# EasyEDA Pro project 成图大赛比赛样题参考.eprj (continued)
## Sheets (continued)
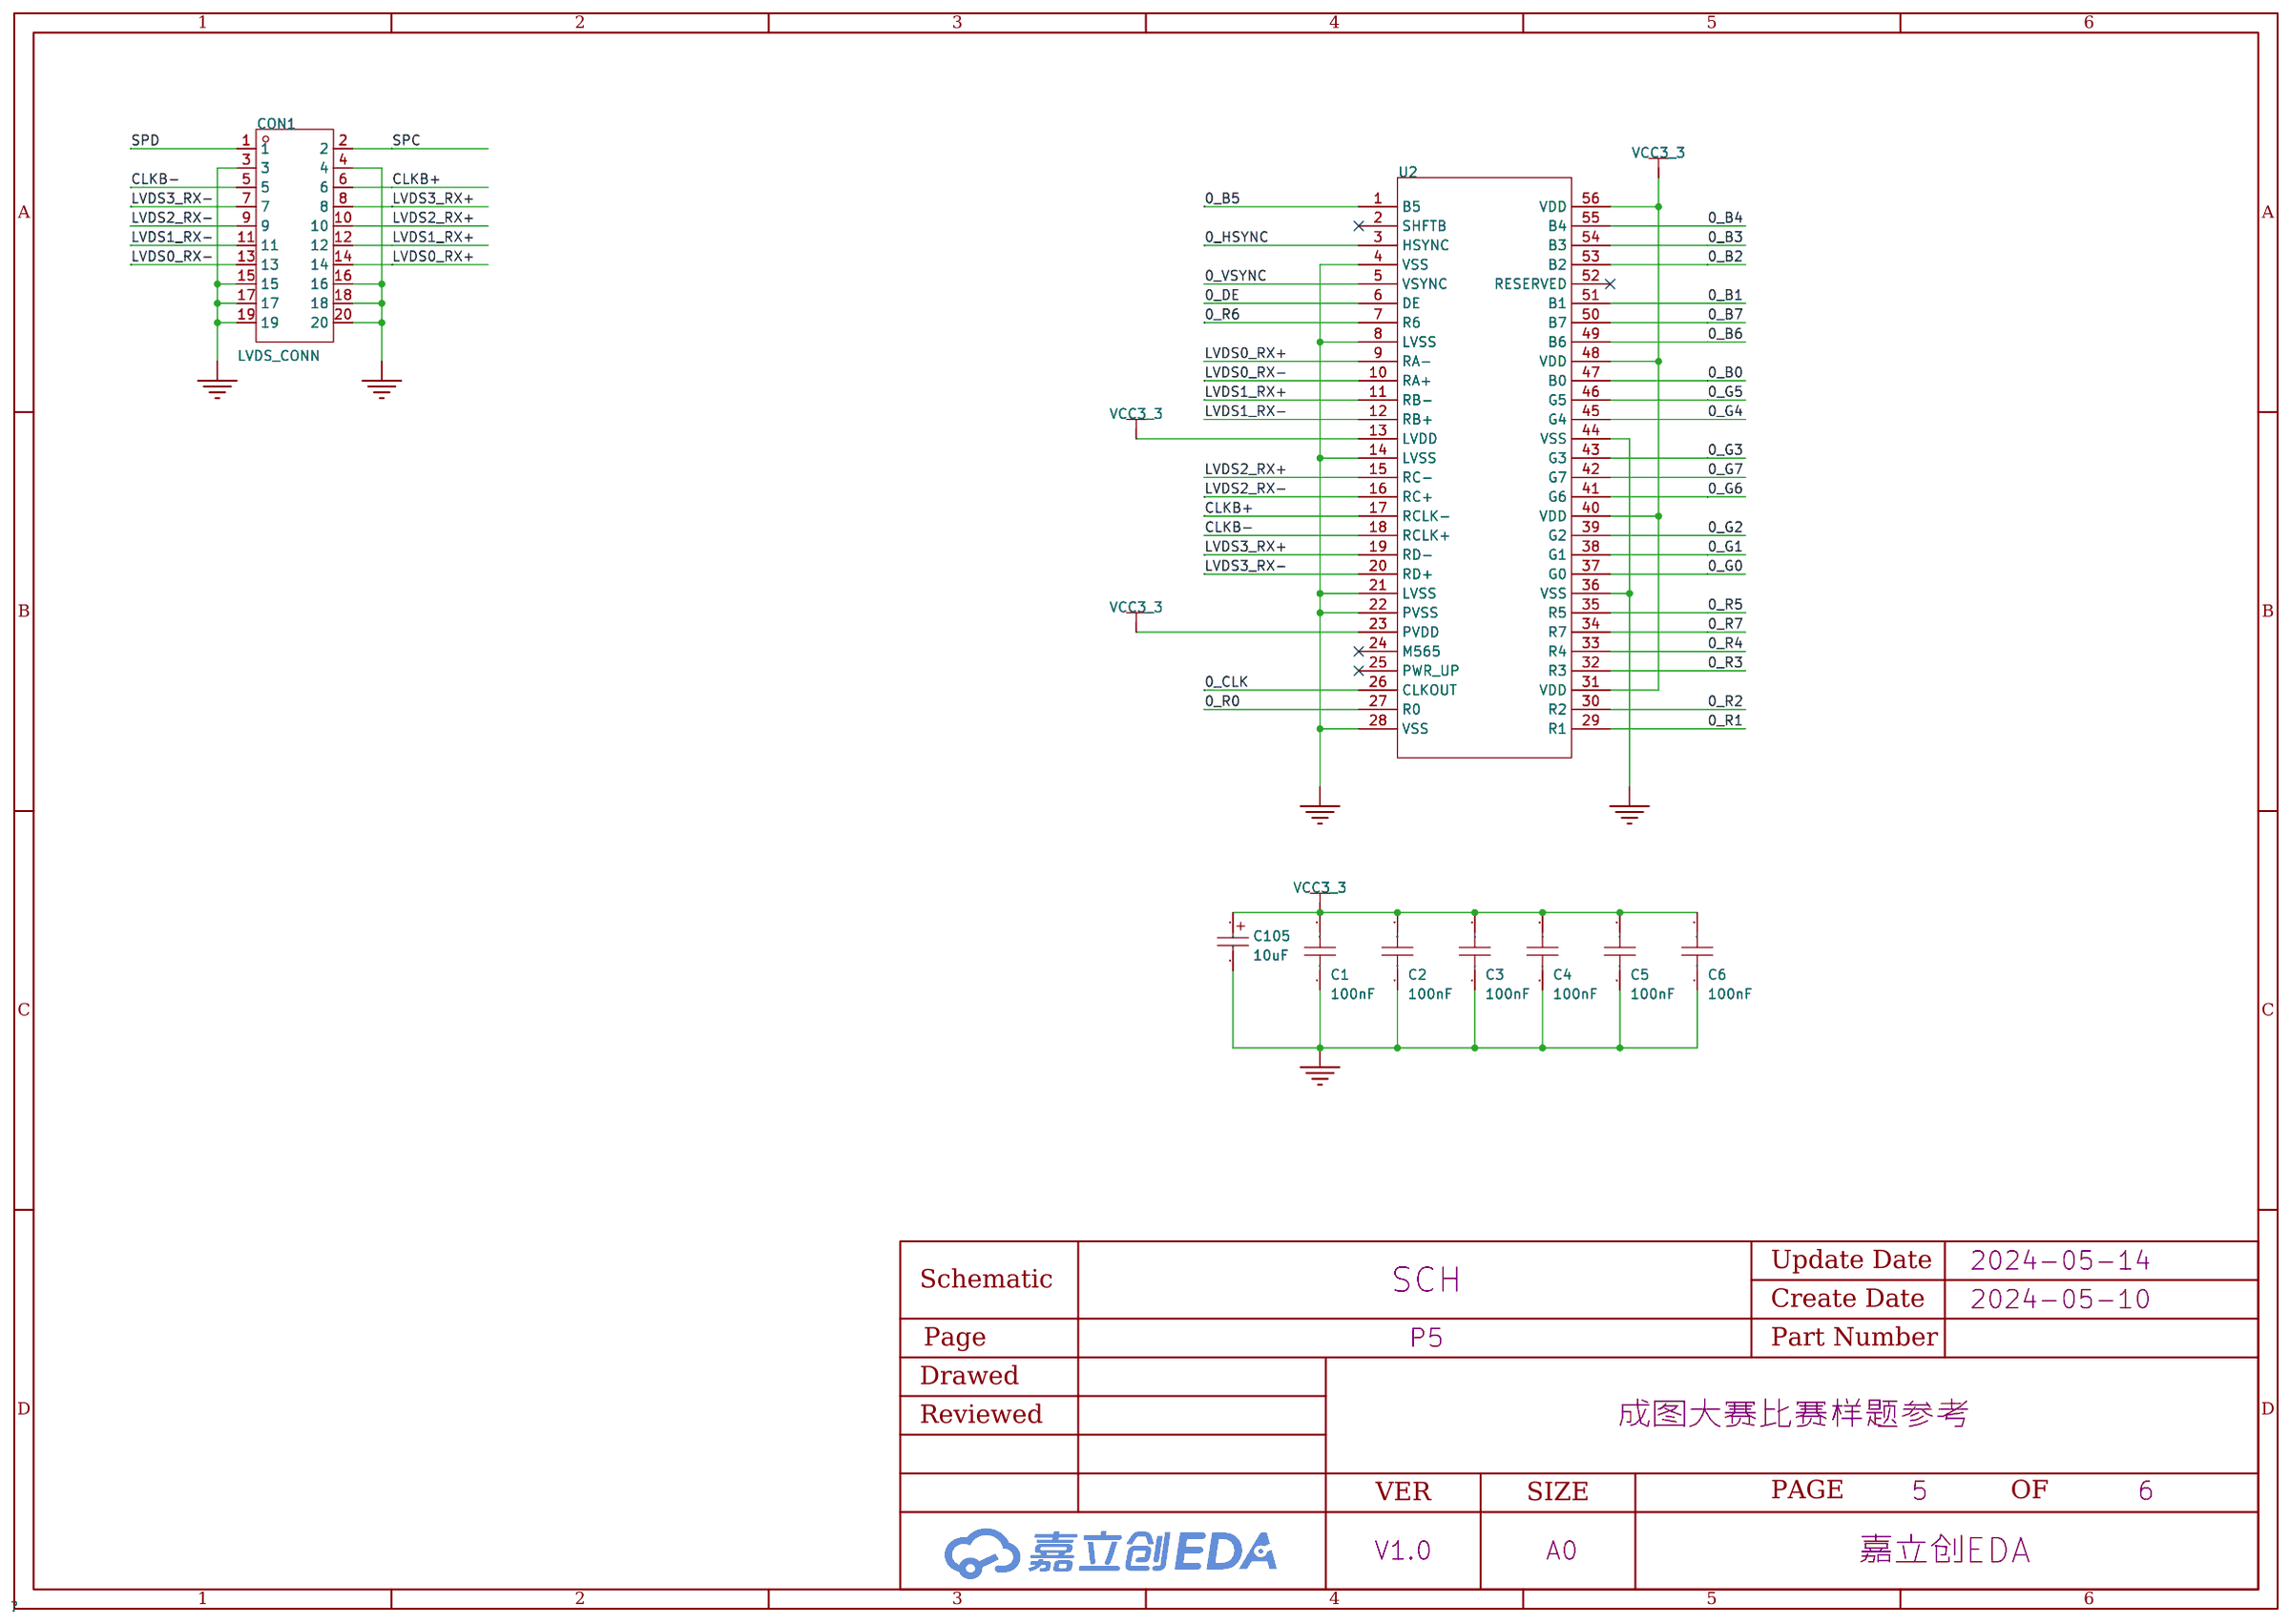
[diagram p4: P5]
6 P6: Page Name: P6
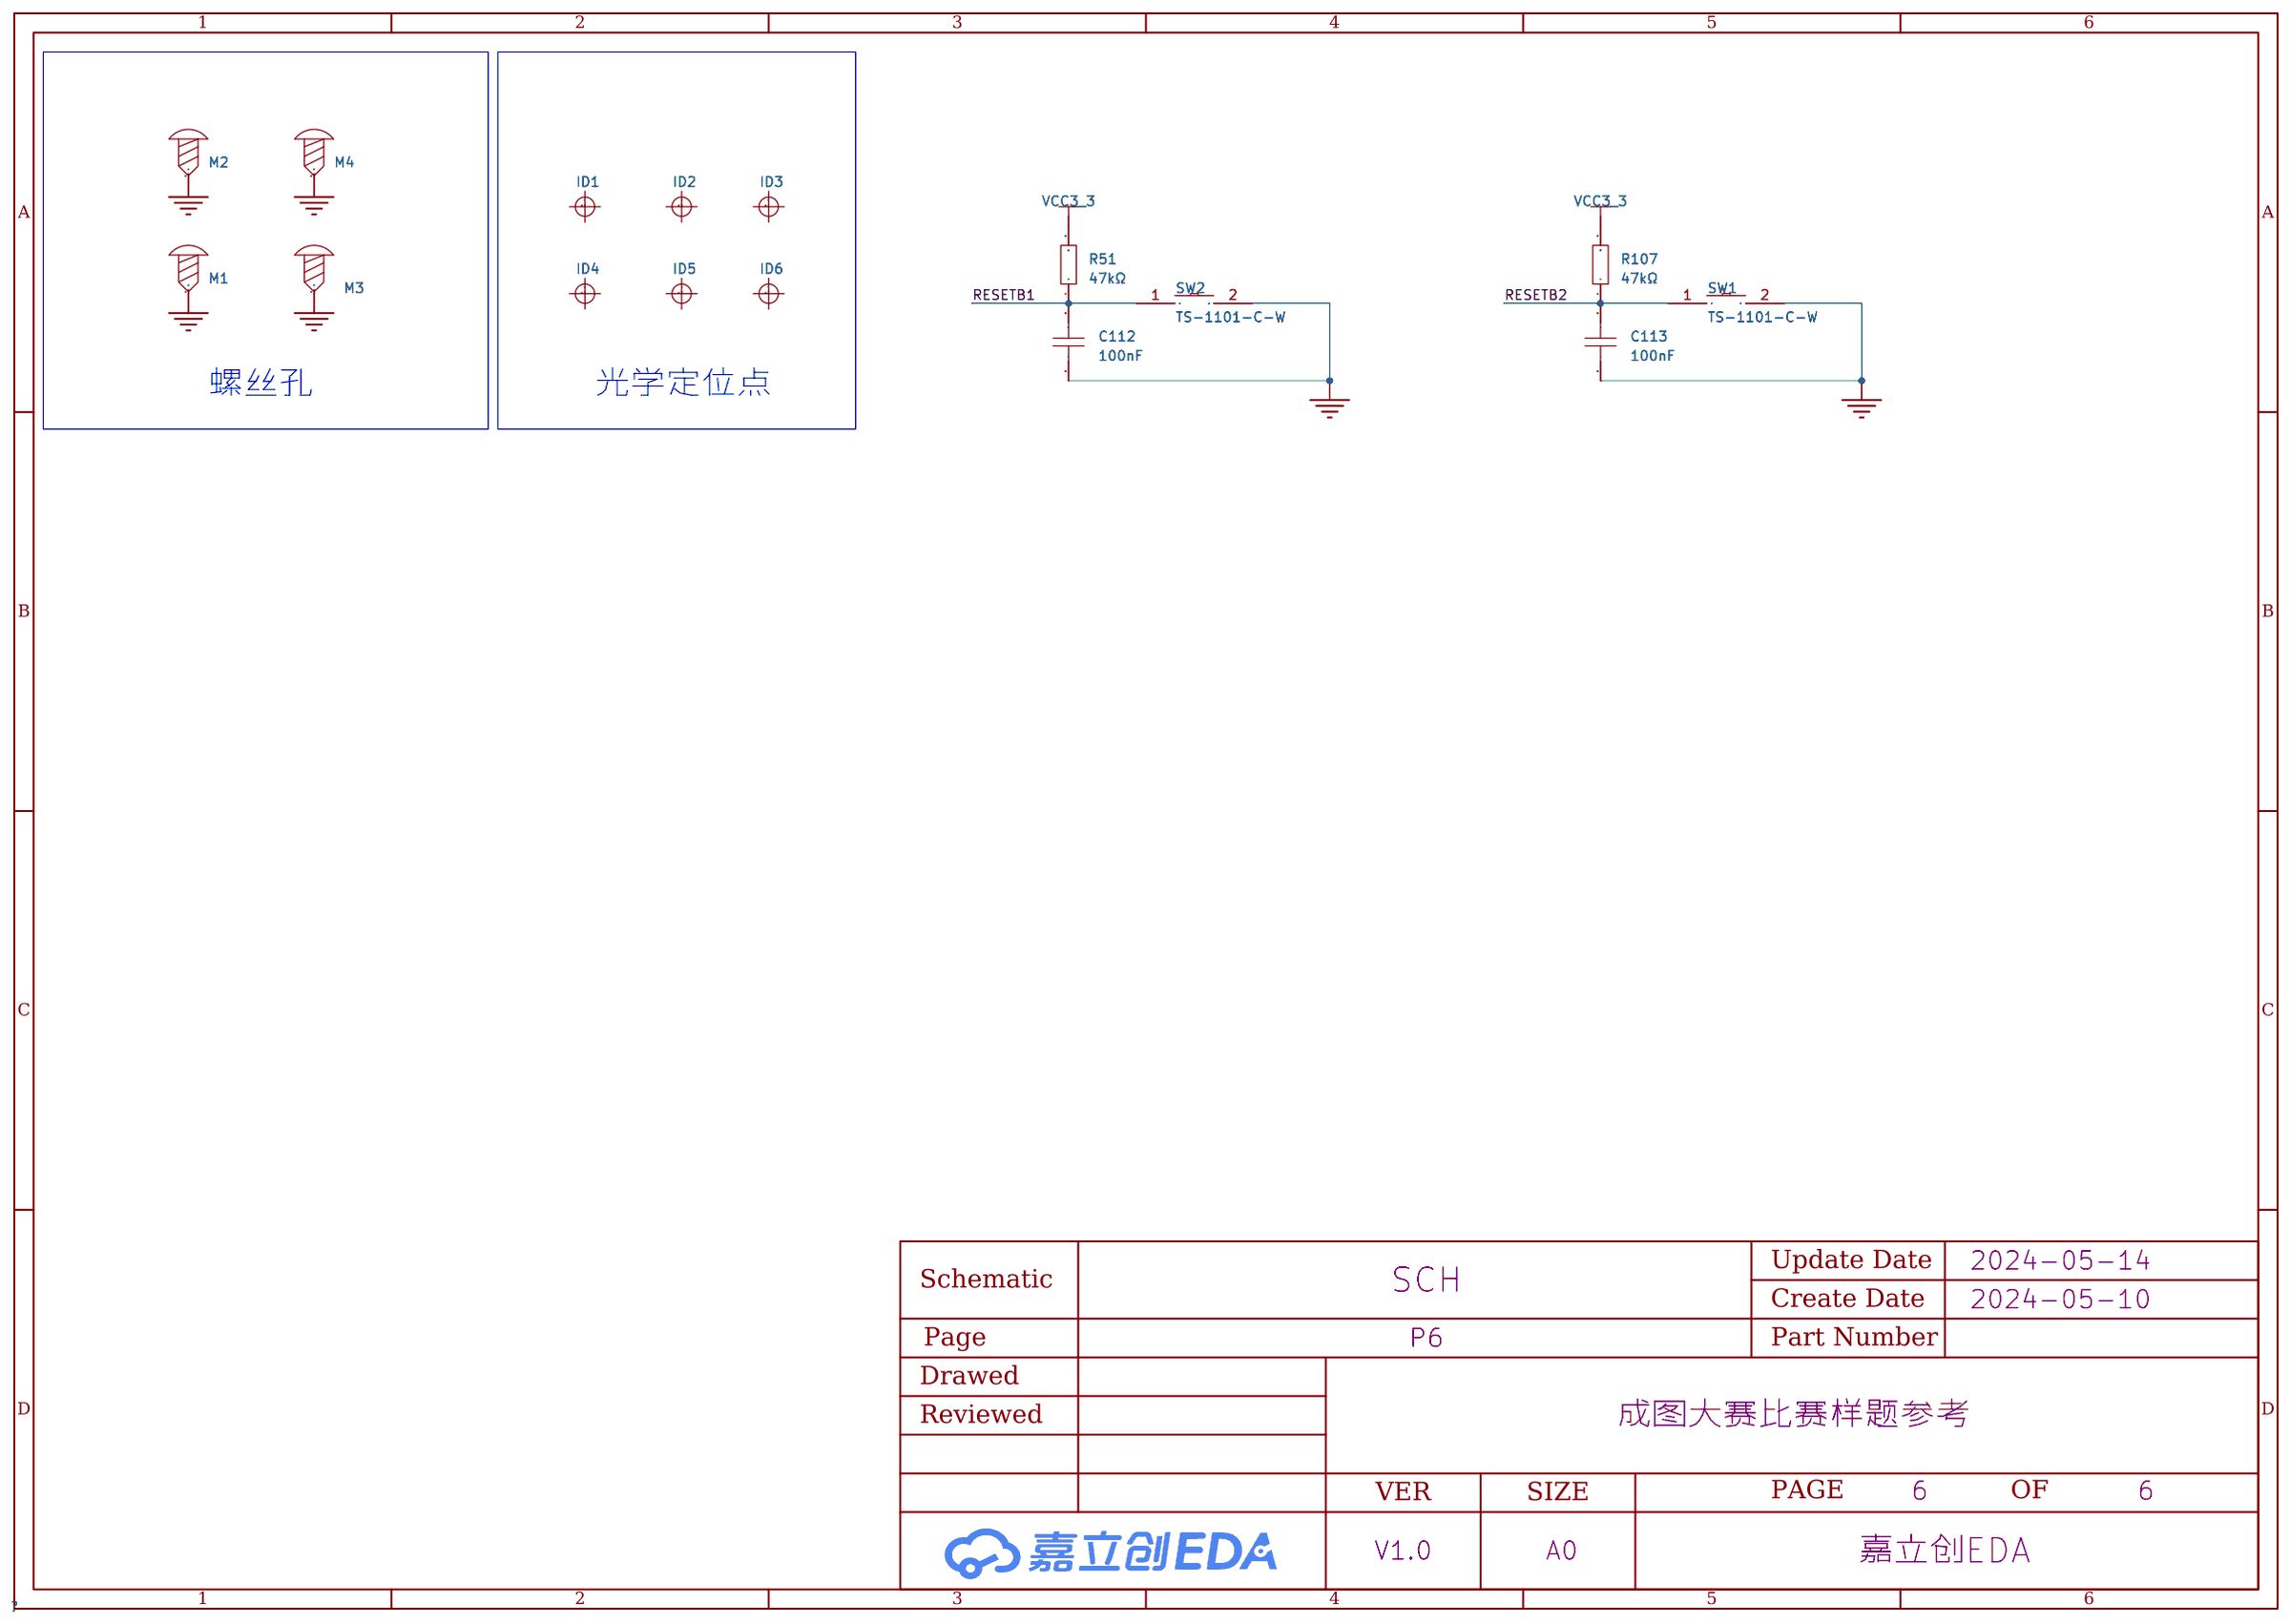
[diagram p5: P6]

## Parts
sheet P1
C7  100nF  [C0603]
C8  100nF  [C0603]
C9  10uF  [CASE-B_3528]
C10  100nF  [C0603]
C11  100nF  [C0603]
C12  10uF  [CASE-B_3528]
C13  10uF  [CASE-B_3528]
C14  100nF  [C0603]
C15  100nF  [C0603]
F1  BSMD1812-200-30V  [F1812]
J1  KH-BNC50-3511  [ANT-TH_KH-BNC50-3511]
U6  AMS1117-3.3  [SOT-89_L4.5-W2.5-P1.50-LS4.2-BR]
sheet P2
C16  22pF  [C0603]
C17  22pF  [C0603]
C18  100nF  [C0603]
C19  100nF  [C0603]
C20  100nF  [C0603]
C21  100nF  [C0603]
C22  100nF  [C0603]
C23  100nF  [C0603]
C30  100nF  [C0603]
C31  100nF  [C0603]
C32  100nF  [C0603]
C33  100nF  [C0603]
C34  100nF  [C0603]
C35  100nF  [C0603]
C106  10uF  [CASE-B_3528]
C107  10uF  [CASE-B_3528]
R1  22Ω  [R0603]
R2  22Ω  [R0603]
R3  22Ω  [R0603]
R4  22Ω  [R0603]
R5  22Ω  [R0603]
R6  22Ω  [R0603]
R7  22Ω  [R0603]
R8  22Ω  [R0603]
R9  22Ω  [R0603]
R10  22Ω  [R0603]
R11  22Ω  [R0603]
R12  22Ω  [R0603]
R13  22Ω  [R0603]
R14  22Ω  [R0603]
R16  22Ω  [R0603]
R17  22Ω  [R0603]
R18  22Ω  [R0603]
R19  22Ω  [R0603]
R20  22Ω  [R0603]
R21  22Ω  [R0603]
R22  22Ω  [R0603]
R23  22Ω  [R0603]
R24  22Ω  [R0603]
R25  22Ω  [R0603]
R26  22Ω  [R0603]
R27  22Ω  [R0603]
R29  22Ω  [R0603]
R30  22Ω  [R0603]
U1  CPU  [QFN-88_L12.0-W12.0-P0.50-TL]
X1  535-9118-1-ND(13MHz)  [OSC-SMD_4P-L7.0-W5.0-BL]
sheet P3
C24  33pF  [C0603]
C25  33pF  [C0603]
C26  33pF  [C0603]
C27  33pF  [C0603]
C28  33pF  [C0603]
C29  33pF  [C0603]
C36  100nF  [C0603]
C37  100nF  [C0603]
C38  1nF  [C1206]
C39  33pF  [C0603]
C40  33pF  [C0603]
C41  33pF  [C0603]
D1  BAT54SLT1G  [SOT-23_L2.9-W1.3-P1.90-LS2.4-BR]
D2  BAT54SLT1G  [SOT-23_L2.9-W1.3-P1.90-LS2.4-BR]
D3  BAT54SLT1G  [SOT-23_L2.9-W1.3-P1.90-LS2.4-BR]
D4  BAT54SLT1G  [SOT-23_L2.9-W1.3-P1.90-LS2.4-BR]
D5  BAT54SLT1G  [SOT-23_L2.9-W1.3-P1.90-LS2.4-BR]
L1  82nH  [L0603]
L2  82nH  [L0603]
L3  150-220R 100Mhz  [L0603]
L4  82nH  [L0603]
L5  82nH  [L0603]
L6  150-220R 100Mhz  [L0603]
L7  82nH  [L0603]
L8  82nH  [L0603]
P1  DS1038-15FBNSiA74-0CC  [DSUB-TH_DS1038-15FBNSIA74-0CC]
R15  22Ω  [R0603]
R28  22Ω  [R0603]
R31  22Ω  [R0603]
sheet P4
BNC1  KH-BNC50-3511  [ANT-TH_KH-BNC50-3511]
BNC2  KH-BNC50-3511  [ANT-TH_KH-BNC50-3511]
BNC3  KH-BNC50-3511  [ANT-TH_KH-BNC50-3511]
BNC4  KH-BNC50-3511  [ANT-TH_KH-BNC50-3511]
C49  100nF  [C0603]
C51  100nF  [C0603]
C53  100nF  [C0603]
C54  100nF  [C0603]
C56  100nF  [C0603]
C57  100nF  [C0603]
C100  10nF  [C0603]
C101  10nF  [C0603]
C102  10nF  [C0603]
C103  10nF  [C0603]
C108  10uF  [CASE-B_3528]
JP1  HDR4  [HDR-TH_4P-P2.54-V-M]
L9  150-220R 100Mhz  [L0603]
R36  47kΩ  [R0603]
R37  47kΩ  [R0603]
R39  47kΩ  [R0603]
R40  47kΩ  [R0603]
R41  47kΩ  [R0603]
R42  47kΩ  [R0603]
R45  47kΩ  [R0603]
R46  47kΩ  [R0603]
R47  47kΩ  [R0603]
R48  47kΩ  [R0603]
R49  47kΩ  [R0603]
R100  75Ω  [R0603]
R101  75Ω  [R0603]
R102  75Ω  [R0603]
R103  75Ω  [R0603]
R104  0Ω  [R0603]
U5  CS8416-CSZ  [SOIC-28_L17.9-W7.5-P1.27-LS10.3-BL]
sheet P5
C1  100nF  [C0603]
C2  100nF  [C0603]
C3  100nF  [C0603]
C4  100nF  [C0603]
C5  100nF  [C0603]
C6  100nF  [C0603]
C105  10uF  [CASE-B_3528]
CON1  LVDS_CONN  [CONN-TH_20P-P2.54_0702462001]
U2  -  [TSSOP-56_L14.0-W6.1-P0.50-LS8.1-BL]
sheet P6
C112  100nF  [C0603]
C113  100nF  [C0603]
ID1  -  [Mark-Point-1mm]  (no BOM)
ID2  -  [Mark-Point-1mm]  (no BOM)
ID3  -  [Mark-Point-1mm]  (no BOM)
ID4  -  [Mark-Point-1mm]  (no BOM)
ID5  -  [Mark-Point-1mm]  (no BOM)
ID6  -  [Mark-Point-1mm]  (no BOM)
M1  -  [M3螺丝]
M2  -  [M3螺丝]
M3  -  [M3螺丝]
M4  -  [M3螺丝]
R51  47kΩ  [R0603]
R107  47kΩ  [R0603]
SW1  TS-1101-C-W  [SW-SMD_L6.0-W3.3-LS8.0]
SW2  TS-1101-C-W  [SW-SMD_L6.0-W3.3-LS8.0]

## Library data of the parts
C1-C8 C10 C11 C14 C15 C18-C23 C30-C37 C49 C51 C53 C54 C56 C57 C112 C113 = CC0603KRX7R9BB104: 容值:100nF;精度:±10%;额定电压:50V;材质(温度系数):X7R;; LCSC Part Name: 100nF ±10% 50V; Supplier Part: C14663; Manufacturer: YAGEO(国巨); Supplier Footprint: 0603; JLCPCB Part Class: 基础库; Datasheet: https://atta.szlcsc.com/upload/public/pdf/source/20180910/C282072_33301C7F631E79921B82A8DAC6BCC5B3.pdf; Supplier: LCSC; Tolerance: ±10%; Voltage Rated: 50V; Temperature Coefficient: X7R
C9 C12 C13 C105-C108 = TAJB106K016RNJ: 容值:10uF;精度:±10%;额定电压:16V;等效串联电阻:2.8Ω@100kHz;; LCSC Part Name: 10uF ±10% 16V; Supplier Part: C7193; Manufacturer: Kyocera AVX; Supplier Footprint: CASE-B-3528; JLCPCB Part Class: 扩展库; Datasheet: https://atta.szlcsc.com/upload/public/pdf/source/20160107/1457707750344.pdf; Supplier: LCSC; Tolerance: ±10%; Rated Voltage: 16V; Equivalent Series Resistance(ESR): 2.8Ω@100kHz; Operating Temperature: -55℃~+125℃
F1 = BSMD1812-200-30V: 最大电压:30V;最大电流:40A;保持电流:2A;跳闸电流:4A;; LCSC Part Name: 30V 2A 1812自恢复; Supplier Part: C960026; Manufacturer: BHFUSE(佰宏); Supplier Footprint: 1812; JLCPCB Part Class: 扩展库; Datasheet: https://atta.szlcsc.com/upload/public/pdf/source/20230512/6ED7FF50F668B3AF958C55F12246A840.pdf; Supplier: LCSC; Operating Voltage (Max): 30V; Current Rating (Max): 40A; Hold Current: 2A; Trip Current: 4A; Power Dissipation: 1W; Resistance - Initial (Ri) (Min): 20mΩ; Resistance - Post Trip (R1) (Max): 100mΩ; Maximum Time to Trip: 2s; Operating Temperature: -40℃~+85℃
BNC1-BNC4 J1 = KH-BNC50-3511: 连接器类型:板端;接口类型:内孔;端口数量:1;接口直径:9.5mm;接口长度/高度:-;频率-最大值:3GHz;射频系列:BNC;阻抗:50Ω;样式:弯头;工作温度范围:-55℃~+155℃;; LCSC Part Name: BNC 内孔 弯头; Supplier Part: C2837587; Manufacturer: kinghelm(金航标); Supplier Footprint: 插件; JLCPCB Part Class: 扩展库; Datasheet: https://atta.szlcsc.com/upload/public/pdf/source/20221123/AFF24A942BB0EF6B7776F494013BE75C.pdf; Supplier: LCSC; Connector Type: 板端; Interface Type: 内孔; Number of Ports: 1; Interface Diameter: 9.5mm; Frequency-Max: 3GHz; RF Series: BNC; Impedance: 50Ω; Style: 弯头; Operating Temperature Range: -55℃~+155℃
U6 = AMS1117-3.3_C347256: 输出类型:固定;最大输入电压:12V;输出电压:3.3V;最大输出电流:1A;电源纹波抑制比(PSRR):60dB@(120Hz);输出极性:正极;; LCSC Part Name: 输出:3.3V 电流:1A 耐压:12V; Supplier Part: C347256; Manufacturer: UMW(友台半导体); Supplier Footprint: SOT-89; JLCPCB Part Class: 扩展库; Datasheet: https://atta.szlcsc.com/upload/public/pdf/source/20231109/155D79A26D9DB04352555A58D5969DC8.pdf; Supplier: LCSC; Output Type: 固定; Maximum Input Voltage: 12V; Output Voltage: 3.3V; MAX Output Current: 1A; Power Supply Rejection Ratio (PSRR): 60dB@(120Hz); Dropout Voltage: 1.3V@(1A); Output Polarity: 正极; Number of Outputs: 1
C16 C17 = CC0603JRNPO9BN220: 容值:22pF;精度:±5%;额定电压:50V;材质(温度系数):NP0;; LCSC Part Name: 22pF ±5% 50V; Supplier Part: C105620; Manufacturer: YAGEO(国巨); Supplier Footprint: 0603; JLCPCB Part Class: 扩展库; Datasheet: https://atta.szlcsc.com/upload/public/pdf/source/20170505/1493957838062.pdf; Supplier: LCSC; Tolerance: ±5%; Voltage Rated: 50V; Temperature Coefficient: NP0
R1-R31 = 0603WAF220JT5E: 电阻类型:厚膜电阻;阻值:22Ω;精度:±1%;功率:100mW;最大工作电压:75V;温度系数:±100ppm/℃;; LCSC Part Name: 22Ω ±1% 100mW 厚膜电阻; Supplier Part: C23345; Manufacturer: UNI-ROYAL(厚声); Supplier Footprint: 0603; JLCPCB Part Class: 基础库; Datasheet: https://atta.szlcsc.com/upload/public/pdf/source/20200306/C422600_1E6D84923E4A46A82E41ADD87F860B5C.pdf; Supplier: LCSC; Type: 厚膜电阻; Tolerance: ±1%; Power(Watts): 100mW; Overload Voltage (Max): 75V; Temperature Coefficient: ±100ppm/℃; Operating Temperature Range: -55℃~+155℃
U1 = CPU
X1 = ECS-200-18-20BQ-DS: 频率:20MHz;常温频差:±30ppm;外接负载电容:18pF;频率稳定度(全温):±100ppm;; LCSC Part Name: 20MHz ±30ppm 18pF; Supplier Part: C2449936; Manufacturer: ECS; Supplier Footprint: SMD7050-4P; JLCPCB Part Class: 扩展库; Datasheet: https://atta.szlcsc.com/upload/public/pdf/source/20210417/E7FD3E929328D517C500B0D0AF968716.pdf; Supplier: LCSC; Normal temperature Frequency Tolerance: ±30ppm; External load capacitor: 18pF; Frequency Stability(Full temperature range): ±100ppm; Equivalent Series Resistance (ESR): 40Ω; Operating Temperature: -40℃~+125℃
C24-C29 C39-C41 = CL10C330JB8NNNC: 容值:33pF;精度:±5%;额定电压:50V;材质(温度系数):C0G;; LCSC Part Name: 33pF ±5% 50V; Supplier Part: C1663; Manufacturer: SAMSUNG(三星); Supplier Footprint: 0603; JLCPCB Part Class: 基础库; Datasheet: https://atta.szlcsc.com/upload/public/pdf/source/20160218/1457707763339.pdf; Supplier: LCSC; Tolerance: ±5%; Voltage Rated: 50V; Temperature Coefficient: C0G
C38 = 1206B102K202NT: 容值:1nF;精度:±10%;额定电压:2kV;材质(温度系数):X7R;; LCSC Part Name: 1nF ±10% 2kV; Supplier Part: C9196; Manufacturer: FH(风华); Supplier Footprint: 1206; JLCPCB Part Class: 基础库; Datasheet: https://atta.szlcsc.com/upload/public/pdf/source/20200305/C486355_26A10D38EF8C2A5C37091D0039909270.pdf; Supplier: LCSC; Tolerance: ±10%; Voltage Rated: 2kV; Temperature Coefficient: X7R
D1-D5 = BAT54SLT1G: 二极管配置:1对串联式;正向压降(Vf):800mV@100mA;直流反向耐压(Vr):30V;平均整流电流(Io):200mA;; LCSC Part Name: 电压:30V 电流:200mA; Supplier Part: C19726; Manufacturer: onsemi(安森美); Supplier Footprint: SOT-23; JLCPCB Part Class: 扩展库; Datasheet: https://atta.szlcsc.com/upload/public/pdf/source/20140815/1457707218410.pdf; Supplier: LCSC; Diode Configuration: 1对串联式; Forward Voltage (Vf@If): 800mV@100mA; Reverse Voltage (Vr): 30V; Average Rectified Current (Io): 200mA; Reverse Leakage Current (Ir): 2uA@25V
L1 L2 L4 L5 L7 L8 = SCC1608C82NJSP: 电感值:82nH;精度:±5%;额定电流:300mA;饱和电流(Isat):-;直流电阻(DCR):1Ω;; LCSC Part Name: 82nH ±5%; Supplier Part: C412043; Manufacturer: Sunltech(韩国顺磁); Supplier Footprint: 0603; JLCPCB Part Class: 扩展库; Datasheet: https://atta.szlcsc.com/upload/public/pdf/source/20190819/C412052_7E47CA9107AD18C13168C896A90007C8.pdf; Supplier: LCSC; Tolerance: ±5%; Rated Current: 300mA; DC Resistance (DCR): 1Ω
L3 L6 L9 = BLM18EG221SN1D: 标称阻抗@测试频率:220Ω@100MHz;误差:±25%;直流电阻(RDC):50mΩ;; LCSC Part Name: 单路 0603磁珠 阻抗220Ω@100MHz; Supplier Part: C85827; Manufacturer: muRata(村田); Supplier Footprint: 0603; JLCPCB Part Class: 扩展库; Datasheet: https://atta.szlcsc.com/upload/public/pdf/source/20170523/1495533955417.pdf; Supplier: LCSC; Impedance @ Frequency: 220Ω@100MHz; Tolerance: ±25%; DC Resistance: 50mΩ; Current Rating: 2A; Circuits: 1
P1 = DS1038-15FBNSiA74-0CC: 连接器类型:D-Sub;公母:母;总PIN位数:15P;安装方式:弯插;排数:3;额定电流:1.5A;工作温度范围:-40℃~+105℃;; LCSC Part Name: D-Sub 母 P数:15P 黑色; Supplier Part: C75754; Manufacturer: VGA; Supplier Footprint: 弯插; JLCPCB Part Class: 扩展库; Datasheet: https://atta.szlcsc.com/upload/public/pdf/source/20160702/1467448308943.pdf; Supplier: LCSC; Connector Type: D-Sub; Gender: 母; Number of Pins: 15P; Mounting Style: 弯插; Number of Rows: 3; Current Rating (Max): 1.5A; Operating Temperature Range: -40℃~+105℃
C100-C103 = CC0603KRX7R9BB103: 容值:10nF;精度:±10%;额定电压:50V;材质(温度系数):X7R;; LCSC Part Name: 10nF ±10% 50V; Supplier Part: C100042; Manufacturer: YAGEO(国巨); Supplier Footprint: 0603; JLCPCB Part Class: 扩展库; Datasheet: https://atta.szlcsc.com/upload/public/pdf/source/20181008/C309510_22F155564471FAF6A489F7D68F34234E.pdf; Supplier: LCSC; Tolerance: ±10%; Voltage Rated: 50V; Temperature Coefficient: X7R
JP1 = PZ254V-11-04P: 插针结构:1x4P;间距:2.54mm;行距:-;圆针/方针:方针;安装类型:直插;排数:单排;总PIN位数:4P;额定电流:3A;额定电压:250V;配合针长度:6mm;塑高:2.5mm;端接针长度:3mm;触头材质:-;工作温度范围:-40℃~+105℃;颜色:黑色;; LCSC Part Name: 间距:2.54mm 1x4P 直插 方针; Supplier Part: C2691448; Manufacturer: XFCN(兴飞); Supplier Footprint: 插件,P=2.54mm; JLCPCB Part Class: 扩展库; Datasheet: https://atta.szlcsc.com/upload/public/pdf/source/20200309/C492403_F9F19131791D08044AD4F84F8E751A34.pdf; Supplier: LCSC; Pin Structure: 1x4P; Pitch: 2.54mm; Circluar Pins/Square Pins: 方针; Mounting Type: 直插; Number of Rows: 单排; Number of Pins: 4P; Current Rating (Max): 3A; Voltage Rating (Max): 250V; Length of Mating Pin: 6mm; Insulation Height: 2.5mm; Length of End Connection Pin: 3mm; Operating Temperature Range: -40℃~+105℃; Color: 黑色
R36 R37 R39-R42 R45-R49 R51 R107 = 0603WAF4702T5E: 电阻类型:厚膜电阻;阻值:47kΩ;精度:±1%;功率:100mW;最大工作电压:75V;温度系数:±100ppm/℃;; LCSC Part Name: 47kΩ ±1% 100mW 厚膜电阻; Supplier Part: C25819; Manufacturer: UNI-ROYAL(厚声); Supplier Footprint: 0603; JLCPCB Part Class: 基础库; Datasheet: https://atta.szlcsc.com/upload/public/pdf/source/20200306/C422600_1E6D84923E4A46A82E41ADD87F860B5C.pdf; Supplier: LCSC; Type: 厚膜电阻; Tolerance: ±1%; Power(Watts): 100mW; Overload Voltage (Max): 75V; Temperature Coefficient: ±100ppm/℃; Operating Temperature Range: -55℃~+155℃
R100-R103 = 0603WAF750JT5E: 电阻类型:厚膜电阻;阻值:75Ω;精度:±1%;功率:100mW;最大工作电压:75V;温度系数:±200ppm/℃;; LCSC Part Name: 75Ω ±1% 100mW 厚膜电阻; Supplier Part: C4275; Manufacturer: UNI-ROYAL(厚声); Supplier Footprint: 0603; JLCPCB Part Class: 基础库; Datasheet: https://atta.szlcsc.com/upload/public/pdf/source/20200306/C422600_1E6D84923E4A46A82E41ADD87F860B5C.pdf; Supplier: LCSC; Type: 厚膜电阻; Tolerance: ±1%; Power(Watts): 100mW; Overload Voltage (Max): 75V; Temperature Coefficient: ±200ppm/℃; Operating Temperature Range: -55℃~+155℃
R104 = 0603WAF0000T5E: 电阻类型:厚膜电阻;阻值:0Ω;精度:±1%;功率:100mW;最大工作电压:75V;; LCSC Part Name: 0Ω ±1% 100mW 厚膜电阻; Supplier Part: C21189; Manufacturer: UNI-ROYAL(厚声); Supplier Footprint: 0603; JLCPCB Part Class: 基础库; Datasheet: https://atta.szlcsc.com/upload/public/pdf/source/20200306/C422600_1E6D84923E4A46A82E41ADD87F860B5C.pdf; Supplier: LCSC; Type: 厚膜电阻; Tolerance: ±1%; Power(Watts): 100mW; Overload Voltage (Max): 75V; Operating Temperature Range: -55℃~+155℃
U5 = CS8416-CSZ: 类型:接收器;接口:I2C；SPI;; LCSC Part Name: 192kHz Digital Audio Interface Receiver; Supplier Part: C1519978; Manufacturer: Cirrus Logic(凌云); Supplier Footprint: SOIC-28-300mil; JLCPCB Part Class: 扩展库; Datasheet: https://atta.szlcsc.com/upload/public/pdf/source/20220509/B22F8DA02A52EBB4925CFBD855A9F23F.pdf; Supplier: LCSC; Type: 接收器; Interface: I2C；SPI; Supply Voltage: 3.3V~5V; Operating Temperature: -10℃~+70℃
CON1 = BH254V-20P: 连接器类型:简牛座;间距:-;结构:2x10P;额定电流:3A;额定电压:250V;封装形式:直插;行距:2.54mm;排数:2;每排PIN数:10;触头材质:-;触头镀层:-;工作温度范围:-40℃~+105℃;焊接温度(最大值):-;; LCSC Part Name: 2x10P 排数:2 每排P数:10; Supplier Part: C492444; Manufacturer: XFCN(兴飞); Supplier Footprint: 插件,P=2.54mm; JLCPCB Part Class: 扩展库; Datasheet: https://atta.szlcsc.com/upload/public/pdf/source/20200312/C492444_4AABE2FC4F6BE8226B85135616AF0092.pdf; Supplier: LCSC; Connector Type: 简牛座; Structure: 2x10P; Current Rating (Max): 3A; Voltage Rating (Max): 250V; Holder Type: 直插; Row Spacing: 2.54mm; Number of Rows: 2; Pin Number in each Row: 10; Operating Temperature Range: -40℃~+105℃
U2 = LVDS2RGB
ID1-ID6 = Mark-Point: Mark点
M1-M4 = M3螺丝: Supplier Footprint: 插件
SW1 SW2 = TS-1101-C-W: 电路结构:单刀单掷;按钮形状:矩形按钮;作用力:260gf;安装方式:立贴;开关长度:6mm;开关宽度:3.6mm;开关高度:2.5mm;带支架:不带;触点电流:50mA;额定电压(AC):-;额定电压(DC):12V;额定功率:-;绝缘电阻:-;带灯:无;机械寿命:5万次;; LCSC Part Name: 6*3.6*2.5mm 立贴 轻触开关; Supplier Part: C318938; Manufacturer: XKB Connectivity(中国星坤); Supplier Footprint: SMD; JLCPCB Part Class: 扩展库; Datasheet: https://atta.szlcsc.com/upload/public/pdf/source/20200227/C318938_C2E53B1EEDE37D980A33616AC086DE53.pdf; Supplier: LCSC; Circuit: 单刀单掷; Actuator Style: 矩形按钮; Operating Force: 260gf; Mounting Style: 立贴; Switch Length: 6mm; Switch Width: 3.6mm; Switch Height: 2.5mm; Strike Gundam: 不带; Contact Current: 50mA; Voltage Rating (DC): 12V; Actuator/Cap Color: 白色带淡绿; With Lamp: 无; Mechanical Life: 5万次; Operating Temperature: -30℃~+85℃

## Nets
+5V: F1.1 J1.1(OUT)
AGND: BNC1.2 BNC1.3 BNC1.4 BNC2.2 BNC2.3 BNC2.4 BNC3.2 BNC3.3 BNC3.4 BNC4.2 BNC4.3 BNC4.4 C49.1 C51.1 C53.1 C54.1 C108.2 R100.1 R101.1 R102.1 R103.1 R104.2 U5.7(AGND)
GND: C1.1 C2.1 C3.1 C4.1 C5.1 C6.1 C7.1 C8.1 C9.2 C10.1 C11.1 C12.2 C13.2 C14.1 C15.1 C16.1 C17.2 C18.1 C19.1 C20.1 C21.1 C22.1 C23.1 C24.1 C25.1 C26.1 C27.1 C28.1 C29.1 C30.1 C31.1 C32.1 C33.1 C34.1 C35.1 C36.1 C37.1 C38.1 C39.1 C40.1 C41.1 C56.1 C57.1 C105.2 C106.2 C107.2 C112.1 C113.1 CON1.3 CON1.4 CON1.15 CON1.16 CON1.17 CON1.18 CON1.19 CON1.20 D1.1(A) D2.1(A) D3.1(A) D4.1(A) D5.1(A) J1.2 J1.3 J1.4 JP1.4 M1.1 M2.1 M3.1 M4.1 P1.6 P1.7 P1.8 P1.10 R15.1 R28.1 R31.1 R41.1 R45.1 R46.1 R104.1 SW1.2 SW2.2 U1.54(SPC) U2.4(VSS) U2.8(LVSS) U2.14(LVSS) U2.21(LVSS) U2.22(PVSS) U2.28(VSS) U2.36(VSS) U2.44(VSS) U5.10(RXSEL1) U5.11(RXSEL0) U5.22(DGND) U5.25(OMCK) U6.1(ADJ(GND)) X1.2(GND) X1.4(GND)
PGND: C38.2 P1.16 P1.17
VCC3_3: C1.2 C2.2 C3.2 C4.2 C5.2 C6.2 C9.1 C10.2 C11.2 C18.2 C19.2 C20.2 C21.2 C22.2 C23.2 C30.2 C31.2 C32.2 C33.2 C34.2 C35.2 C56.2 C57.2 C105.1 C106.1 C107.1 L9.1 R37.1 R39.1 R40.1 R42.1 R47.1 R48.1 R49.1 R51.2 R107.2 U2.13(LVDD) U2.23(PVDD) U2.31(VDD) U2.40(VDD) U2.48(VDD) U2.56(VDD) U5.21(VL) U5.23(VD) U6.2(VOUT(TAB))
VDD5: C7.2 C8.2 C12.1 C13.1 C14.2 C15.2 D1.2(C) D2.2(C) D3.2(C) D4.2(C) D5.2(C) F1.2 U6.3(VIN)
0_B0: R18.1 U2.47(B0)
0_B1: R19.1 U2.51(B1)
0_B2: R20.1 U2.53(B2)
0_B3: R21.1 U2.54(B3)
0_B4: R22.1 U2.55(B4)
0_B5: R23.1 U2.1(B5)
0_B6: R24.1 U2.49(B6)
0_B7: R25.1 U2.50(B7)
0_CLK: R30.1 U2.26(CLKOUT)
0_DE: R29.1 U2.6(DE)
0_G0: R9.1 U2.37(G0)
0_G1: R10.1 U2.38(G1)
0_G2: R11.1 U2.39(G2)
0_G3: R12.1 U2.43(G3)
0_G4: R13.1 U2.45(G4)
0_G5: R14.1 U2.46(G5)
0_G6: R16.1 U2.41(G6)
0_G7: R17.1 U2.42(G7)
0_HSYNC: R26.1 U2.3(HSYNC)
0_R0: R1.1 U2.27(R0)
0_R1: R2.1 U2.29(R1)
0_R2: R3.1 U2.30(R2)
0_R3: R4.1 U2.32(R3)
0_R4: R5.1 U2.33(R4)
0_R5: R6.1 U2.35(R5)
0_R6: R7.1 U2.7(R6)
0_R7: R8.1 U2.34(R7)
0_VSYNC: R27.1 U2.5(VSYNC)
AVC33: C53.2 C108.1 L9.2 U5.6(VA)
BLUE: C41.2 D3.3(A/C) L8.2 P1.3
CLKB+: CON1.6 U2.17(RCLK-)
CLKB-: CON1.5 U2.18(RCLK+)
D0: R1.2
D1: R2.2
D2: R3.2
D3: R4.2
D4: R5.2
D5: R6.2
D6: R7.2
D7: R8.2
D8: R9.2
D9: R10.2
D10: R11.2
D11: R12.2
D12: R13.2
D13: R14.2
D14: R16.2
D15: R17.2
D16: R18.2
D17: R19.2
D18: R20.2
D19: R21.2
D20: R22.2
D21: R23.2
D22: R24.2
D23: R25.2
DAC0: C24.2 L1.1 R15.2
DAC1: C27.2 L4.1 R28.2
DAC2: C39.2 L7.1 R31.2
DE/CSB: R29.2
GCLK: R30.2
GREEN: C29.2 D2.3(A/C) L5.2 P1.2
H/WEB: R26.2
HSO: D4.3(A/C) L3.1
HSYNC: C36.2 L3.2 P1.13
I2S_CK: JP1.2 U5.27(OSCLK)
I2S_D: JP1.3 R41.2 U5.26(SDOUT)
I2S_WS: JP1.1 U5.28(OLRCK)
LVDS0_RX+: CON1.14 U2.9(RA-)
LVDS0_RX-: CON1.13 U2.10(RA+)
LVDS1_RX+: CON1.12 U2.11(RB-)
LVDS1_RX-: CON1.11 U2.12(RB+)
LVDS2_RX+: CON1.10 U2.15(RC-)
LVDS2_RX-: CON1.9 U2.16(RC+)
LVDS3_RX+: CON1.8 U2.19(RD-)
LVDS3_RX-: CON1.7 U2.20(RD+)
RED: C26.2 D1.3(A/C) L2.2 P1.1
RESETB1: C112.2 R51.1 SW2.1
RESETB2: C113.2 R107.1 SW1.1 U5.9(RST#)
SPC: CON1.2
SPD: CON1.1
SPDOF_IN_1: C100.2 U5.1(RXP3)
SPDOF_IN_2: C101.2 U5.2(RXP2)
SPDOF_IN_3: C102.2 U5.3(RXP1)
SPDOF_IN_4: C103.2 U5.4(RXP0)
V: R27.2
VSO: D5.3(A/C) L6.1
VSYNC: C37.2 L6.2 P1.14
XI: C17.1 X1.1(OSC1)
XO: C16.2 X1.3(OSC2)
Net-(BNC1-1): BNC1.1(OUT) C100.1 R100.2
Net-(BNC2-1): BNC2.1(OUT) C101.1 R101.2
Net-(BNC3-1): BNC3.1(OUT) C102.1 R102.2
Net-(BNC4-1): BNC4.1(OUT) C103.1 R103.2
Net-(C25-2): C25.2 L1.2 L2.1
Net-(C28-2): C28.2 L4.2 L5.1
Net-(C40-2): C40.2 L7.2 L8.1
Net-(C49-2): C49.2 U5.5(RXN)
Net-(C51-2): C51.2 R36.2
Net-(C54-2): C54.2 R36.1 U5.8(FILT)
Net-(R37-2): R37.2 U5.20(TX)
Net-(R39-2): R39.2 U5.19(C)
Net-(R40-2): R40.2 U5.18(U)
Net-(R42-2): R42.2 U5.17(RCBL)
Net-(R45-2): R45.2 U5.16(96KHZ)
Net-(R46-2): R46.2 U5.15(AUDIO)
Net-(R47-2): R47.2 U5.12(TXSEL1)
Net-(R48-2): R48.2 U5.13(TXSEL0)
Net-(R49-2): R49.2 U5.14(NV/RERR)

Not connected (* = marked no-connect by the designer): ID1 1; ID2 1; ID3 1; ID4 1; ID5 1; ID6 1; P1 4* 5* 9* 11* 12* 15*; U1 1(D21) 2(D20) 3(D19) 4(D18) 5(D17) 6(D16) 7(RESETB) 8(D15) 9(VDDMS) 10(DVDD) 11(GNDMS) 12(D14) 13(D13) 14(D12) 15(D11) 16(D10) 17(D9) 18(D8) 19(D7) 20(D6) 21(D5) 22(GND) 23(VDD) 24(NC)* 25(D4) 26(D3) 27(D2) 28(D1) 29(D0) 30(VDDH) 31(TXCB) 32(TXC) 33(VSSH) 34(TX0B) 35(TX0) 36(TX1B) 37(TX1) 38(VSSH) 39(TX2B) 40(TX2) 41(VDDH) 42(DVDD) 43(NC) 44(NC) 45(DGND) 46(AVDC) 47(AGND) 48(HSO/CSYNC) 49(VSO) 50(ATPG)* 51(HPD) 52(GNDMQ) 53(VDDMQ) 55(SPD) 56(I2S_D/SPDIF/PWM)* 57(I2S_WS/ENAVDD) 58(I2S_CK/ENABLK) 59(GNDMS) 60(VDDMS)* 61(VDDMQ)* 62(GNDMQ) 63(DDC_SC) 64(DDC_SD) 65(CEC)* 66(NC)* 67(XO) 68(XI) 69(SPDM)* 70(AGND_PLL) 71(AVDD_PLL) 72(SPCM)* 73(AVDD_DAC) 74(DAC2) 75(AGND_DAC) 76(DAC1) 77(AVDD_DAC) 78(DAC0) 79(AGND_DAC) 80(ISET)* 81(IRQ)* 82(GCLK) 83(VDDIO) 84(DE/CSB) 85(V) 86(H/WEB) 87(D23) 88(D22); U2 2(SHFTB)* 24(M565)* 25(PWR_UP)* 52(RESERVED)*; U5 24(RMCK)*

## Notes on the sheets
sheet 6
- 螺丝孔
- 光学定位点
